# EasyEDA Pro project 智能车.eprj, board PCB6
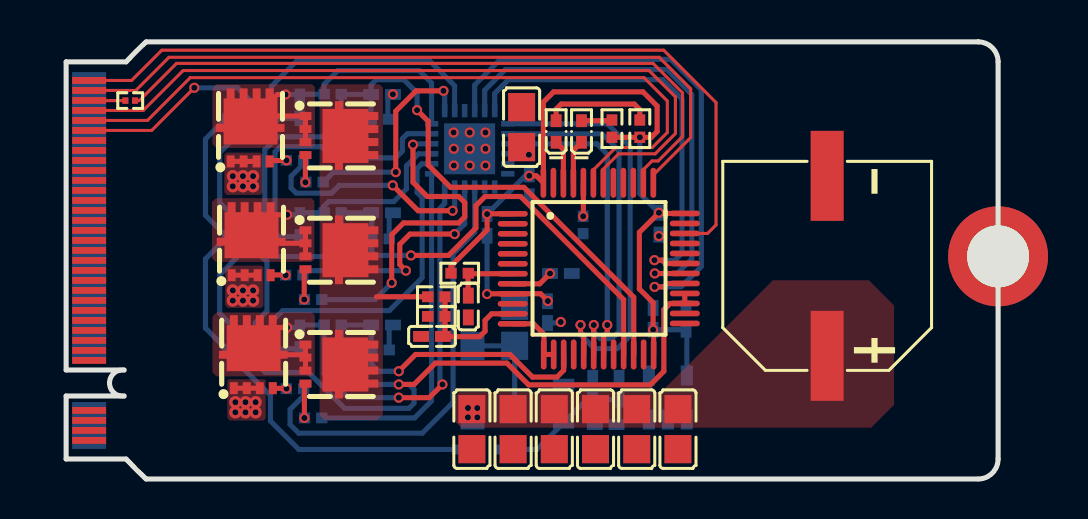
[diagram p18: board, top side]
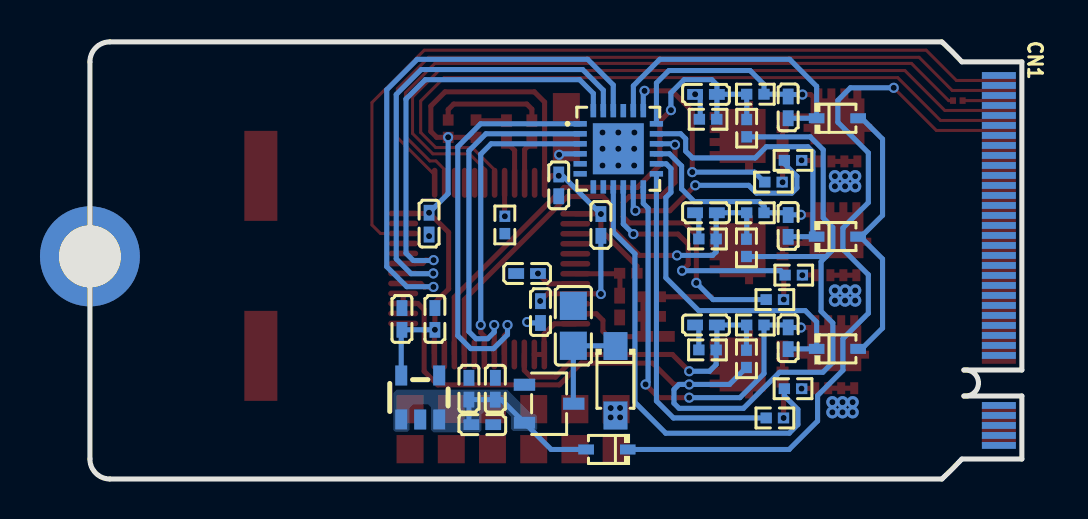
[diagram p19: board, bottom side, seen from below]

Outline 47.95 x 21.95 mm; copper layers: Top Layer, Bottom Layer. Coordinates in mm from the lower left corner of the outline.
Outline path: 5.31,0 46.95,0 arc(47.66,0.29) 47.95,1 47.95,20.86 arc(47.66,21.57) 46.95,21.86 5.33,21.86
Stack: Top Layer 0.035mm / Dielectric1 1.51mm FR4 er 4.5 / Bottom Layer 0.035mm

## Design rules (mm)
template: 自定义配置
spacing copperThickness1oz (default): track to track 0.102, other pairs 0.152 to 0.3
spacing copperThickness2oz: track to track 0.203, other pairs 0.152 to 0.3
track width copperThickness1oz (default): min 0.127, default 0.254, max 2.54
track width copperThickness2oz: min 0.203, default 0.254, max 2.54
differential pair differentialPair (default): width min 0.127, default 0.254, max 2.54; gap min 0.152, default 0.152
via viaSize (default): diameter min 0.5, default 0.61, max 10; hole min 0.3, default 0.305, max 6.299

## Placement (name value [footprint] x y rotation side)
C1  100nF  [C0402]  25.4 8.35 90 bottom
C2  22uF  [C0805]  21.62 2.49 90 top
C3  22uF  [C0805]  23.68 2.49 90 top
C4  22uF  [C0805]  25.74 2.49 90 top
C5  22uF  [C0805]  27.8 2.49 90 top
C6  22uF  [C0805]  29.87 2.49 90 top
C7  22uF  [C0805]  31.93 2.49 90 top
C8  470uF  [CAP-SMD_BD10.0-L10.3-W10.3-LS11.3-FD]  39.4 10.66 90 top
C9  4.7uF  [C0402]  13.01 18.58 270 bottom
C10  4.7uF  [C0402]  13.01 12.65 270 bottom
C11  4.7uF  [C0402]  13.01 7.04 270 bottom
C12  22uF  [C0805]  24.1 17.59 270 top
C25  100nF  [C0402]  17.12 19.23 180 bottom
C26  100nF  [C0402]  17.12 13.31 180 bottom
C27  100nF  [C0402]  17.12 7.7 180 bottom
C28  100nF  [C0402]  30.98 12.77 90 bottom
C29  100nF  [C0402]  24.49 14.68 90 bottom
C30  100nF  [C0402]  30.69 8 270 bottom
C31  100nF  [C0402]  21.44 8.62 90 top
C32  100nF  [C0402]  19.62 7.13 0 top
C33  10uF  [C0402]  32.33 8 270 bottom
C34  10uF  [C0402]  28.31 2.72 0 bottom
C35  22nF  [C0805]  23.76 7.66 270 bottom
C36  10uF  [C0402]  27.66 4.52 270 bottom
C37  100nF  [C0402]  28.98 4.52 270 bottom
CN1  91302-42-067RDM  [M.2_M-KEY]  2.46 10.93 270 bottom
D1  B5819WS  [SOD-323_L1.7-W1.3-LS2.5-FD]  10.54 18.04 0 bottom
D2  B5819WS  [SOD-323_L1.7-W1.3-LS2.5-FD]  10.54 12.12 0 bottom
D3  B5819WS  [SOD-323_L1.7-W1.3-LS2.5-FD]  10.54 6.51 0 bottom
D5  DSK34  [SOD-123FL_L2.7-W1.8-LS3.8-RD]  21.65 4.91 270 bottom
D7  B5819WS  [SOD-323_L1.7-W1.3-LS2.5-FD]  22.07 1.48 180 bottom
L1  CBG100505U000T  [L0402]  22.38 12.7 90 bottom
L2  CBG100505U000T  [L0402]  26.07 10.28 0 bottom
LED1  -  [LED_0402]  27.1 17.38 90 top
LED2  -  [LED_0402]  25.83 17.38 90 top
NOREF  -  [Pad_e695]  47.95 11.13 0 top
R1  10K  [R0402]  27.18 12.7 90 bottom
R2  4.7R  [R0402]  13.67 8.97 180 bottom
R3  4.7R  [R0402]  13.67 3.05 180 bottom
R4  4.7R  [R0402]  12.76 15.94 180 bottom
R5  4.7R  [R0402]  12.73 10.2 180 bottom
R6  4.7R  [R0402]  12.76 4.52 180 bottom
R8  4.7R  [R0402]  13.74 14.85 180 bottom
R19  10K  [R0402]  14.65 19.24 180 bottom
R20  10K  [R0402]  14.65 13.31 180 bottom
R21  10K  [R0402]  14.65 7.7 180 bottom
R22  1K  [R0402]  15.08 17.54 270 bottom
R23  1K  [R0402]  15.09 11.56 270 bottom
R24  1K  [R0402]  15.09 6.01 270 bottom
R25  1K  [R0402]  17.01 17.99 180 bottom
R26  1K  [R0402]  17.04 12 180 bottom
R27  1K  [R0402]  17.04 6.46 180 bottom
R28  10K  [R0402]  21.01 10.29 180 top
R29  1K  [R0402]  28.63 17.52 90 top
R30  2.7K  [R0402]  30.02 17.52 90 top
R31  47K  [R0402]  19.84 9.11 180 top
R32  10K  [R0402]  19.84 8.13 0 top
R34  100  [R0201]  4.52 18.92 180 top
U1  -  [LQFP-48_48P-L7.0-W7.0-P0.50-LS9.7-BL]  27.97 10.52 270 top
U3  TPN2R703NL  [TSON-8_L3.1-W3.1-P0.65-LS3.3-BL-EP]  14.96 17.17 270 top
U4  TPN2R703NL  [TSON-8_L3.1-W3.1-P0.65-LS3.3-BL-EP]  10.52 17.56 0 top
U5  TPN2R703NL  [TSON-8_L3.1-W3.1-P0.65-LS3.3-BL-EP]  14.96 11.46 270 top
U6  TPN2R703NL  [TSON-8_L3.1-W3.1-P0.65-LS3.3-BL-EP]  14.96 5.75 270 top
U7  TPN2R703NL  [TSON-8_L3.1-W3.1-P0.65-LS3.3-BL-EP]  10.57 11.87 0 top
U8  TPN2R703NL  [TSON-8_L3.1-W3.1-P0.65-LS3.3-BL-EP]  10.68 6.22 0 top
U10  FD6288Q  [QFN-24_L4.0-W4.0-P0.50-BL-EP2.6]  21.51 16.51 270 bottom
U11  RT9013-33GB-MS  [SOT-23-5_L2.9-W1.6-P0.95-LS2.8-BR]  31.42 4.08 270 bottom
U12  SE8650X2-HF  [SOT-23-3_L2.9-W1.6-P1.90-LS2.8-BR]  24.97 3.76 0 bottom

## Footprints (pads in the part's own frame, mm; a bottom-side part is the same pattern mirrored in y, then rotated)
C0402
  rect 0.79x0.54 smd: 1(-0.545,0) 2(0.545,0)
C0805
  rect 1.41x1.35 smd: 1(-1,0) 2(1,0)
CAP-SMD_BD10.0-L10.3-W10.3-LS11.3-FD
  rect 4.5x1.65 smd: 1(-4.5,0) 2(4.5,0)
L0402
  rect 0.79x0.54 smd: 1(-0.545,0) 2(0.545,0)
LED_0402
  rect 0.637x0.541 smd: 1(-0.538,0) 2(0.538,0)
LQFP-48_48P-L7.0-W7.0-P0.50-LS9.7-BL
  oval 0.28x1.5 smd: 1(-2.743,-4.306) 2(-2.243,-4.306) 3(-1.742,-4.306) 4(-1.242,-4.306) 5(-0.742,-4.306) 6(-0.241,-4.306) 7(0.257,-4.306) 8(0.757,-4.306) 9(1.258,-4.306) 10(1.758,-4.306) 11(2.258,-4.306) 12(2.759,-4.306) 25(2.743,4.306) 26(2.243,4.306) 27(1.742,4.306) 28(1.242,4.306) 29(0.742,4.306) 30(0.241,4.306) 31(-0.257,4.306) 32(-0.757,4.306) 33(-1.258,4.306) 34(-1.758,4.306) 35(-2.258,4.306) 36(-2.759,4.306)
  oval 1.5x0.28 smd: 13(4.293,-2.756) 14(4.293,-2.256) 15(4.293,-1.755) 16(4.293,-1.255) 17(4.293,-0.754) 18(4.293,-0.254) 19(4.293,0.244) 20(4.293,0.744) 21(4.293,1.244) 22(4.293,1.745) 23(4.293,2.245) 24(4.293,2.745) 37(-4.293,2.731) 38(-4.293,2.23) 39(-4.293,1.73) 40(-4.293,1.23) 41(-4.293,0.729) 42(-4.293,0.229) 43(-4.293,-0.269) 44(-4.293,-0.769) 45(-4.293,-1.27) 46(-4.293,-1.77) 47(-4.293,-2.271) 48(-4.293,-2.771)
M.2_M-KEY
  rect 0.34x1.7 smd: 1(-9.251,0.001) 3(-8.75,0) 5(-8.249,0) 7(-7.75,0) 9(-7.25,0) 11(-6.75,0) 13(-6.25,0) 15(-5.75,0) 17(-5.25,0) 19(-4.75,0) 21(-4.25,0) 23(-3.749,0) 25(-3.249,0) 27(-2.749,0) 29(-2.249,0) 31(-1.75,0) 33(-1.25,0) 35(-0.75,0) 37(-0.249,0) 39(0.251,0) 41(0.75,0) 43(1.25,0) 45(1.75,0) 47(2.251,0) 49(2.751,0) 51(3.251,0) 53(3.751,0) 55(4.25,0) 57(4.75,0) 67(7.25,0) 69(7.75,0) 71(8.251,0) 73(8.751,0) 75(9.251,0)
  rect 0.34x1.7 smd far side: 2(-9.001,0.001) 4(-8.501,0) 6(-8.001,0) 8(-7.501,0) 10(-7.001,0) 12(-6.501,0) 14(-6.001,0) 16(-5.501,0) 18(-5.001,0) 20(-4.499,-0.001) 22(-4.001,0) 24(-3.501,0) 26(-3.001,0) 28(-2.501,0) 30(-2.001,0) 32(-1.501,0) 34(-1.001,0) 36(-0.501,0) 38(-0.001,0) 40(0.499,0) 42(0.998,-0.001) 44(1.499,0) 46(1.999,0) 48(2.499,0) 50(2.999,0) 52(3.499,0) 54(3.999,0) 56(4.499,0) 58(4.999,0) 68(7.499,0) 70(7.999,0) 72(8.499,0) 74(8.999,0)
Pad_e695
  round 5 hole 3.1: 3(0,0)
QFN-24_L4.0-W4.0-P0.50-BL-EP2.6
  rect 0.28x0.665 smd: 1(-1.25,-1.907) 2(-0.75,-1.907) 3(-0.25,-1.907) 4(0.25,-1.907) 5(0.75,-1.907) 6(1.25,-1.907) 13(1.25,1.907) 14(0.75,1.907) 15(0.25,1.907) 16(-0.25,1.907) 17(-0.75,1.907) 18(-1.25,1.907)
  rect 0.665x0.28 smd: 7(1.907,-1.25) 8(1.907,-0.75) 9(1.907,-0.25) 10(1.907,0.25) 11(1.907,0.75) 12(1.907,1.25) 19(-1.907,1.25) 20(-1.907,0.75) 21(-1.907,0.25) 22(-1.907,-0.25) 23(-1.907,-0.75) 24(-1.907,-1.25)
  rect 2.55x2.55 smd: 25(0,0)
R0201
  rect 0.303x0.324 smd: 1(-0.241,0) 2(0.241,0)
R0402
  rect 0.566x0.54 smd: 1(-0.433,0) 2(0.433,0)
SOD-123FL_L2.7-W1.8-LS3.8-RD
  rect 1.4x1.2 smd: 1(-1.735,0) 2(1.735,0)
SOD-323_L1.7-W1.3-LS2.5-FD
  rect 0.78x0.5 smd: 1(-1.04,0) 2(1.04,0)
SOT-23-3_L2.9-W1.6-P1.90-LS2.8-BR
  rect 1.07x0.6 smd: 1(1.235,-0.95) 2(1.235,0.95) 3(-1.235,0)
SOT-23-5_L2.9-W1.6-P0.95-LS2.8-BR
  rect 1x0.6 smd: 1(1.1,-0.95) 2(1.1,0) 3(1.1,0.95) 4(-1.1,0.95) 5(-1.1,-0.95)
TSON-8_L3.1-W3.1-P0.65-LS3.3-BL-EP
  rect 0.4x0.6 smd: 1(-0.975,-1.675) 2(-0.325,-1.675) 3(0.325,-1.675) 4(0.975,-1.675) 5(0.975,1.675) 6(0.325,1.675) 7(-0.325,1.675) 8(-0.975,1.675)
  rect 0.6x0.4 smd: 9(-1.42,0) 9(1.42,0)
  rect 2.7x2.3 smd: 9(0.02,0.325)

## Nets
As in the schematic.

Pads without a net: CN1 20 40; NOREF 3; U1 2 3 4 5 6 10 16 20 25 26 32 33 39 40 41; U10 5 7 8 21; U11 4

## Via types
v1: diameter 0.508, hole 0.305, Top Layer to Bottom Layer, 56 vias
v2: diameter 0.61, hole 0.305, Top Layer to Bottom Layer, 18 vias

## Routing (per net, layer and track width the routed paths; a pad name or vN(x,y) marks a point on that pad's centre or on a via; arc(x,y) is an arc through that point)
3V3: length 39.9
  Top Layer w0.254: R29.1 R30.1 30.59,17.09 30.89,17.38 30.89,18.65 30.18,19.36 25.71,19.36 25.19,18.85 U1.48 24.84,15.16 v1(24.49,15.16) ; U1.24 30.71,7.44 v1(30.68,7.46) 30.68,8.82 30,9.5 30,12.33 v1(30.98,13.31) 31.01,13.28 U1.36 ; R28.2 20.57,10.65 22.38,12.45 v1(22.38,13.25) 22.39,13.26 U1.1
  Bottom Layer w0.254: v1(22.38,13.25) 24.36,15.23 24.49,15.23 ; 32.37,5.18 32.37,7.46 v1(30.68,7.46) ; v1(30.02,17.09) 30.02,14.27 v1(30.98,13.31)
5V: length 8.2
  Bottom Layer w0.254: C34.2 28.98,2.84 C37.2 C36.2 27.36,3.97 26.2,2.81 24.87,1.48 D7.1
GND: length 8.6
  Top Layer w0.254: U8.3 U8.2 U8.1 ; U7.1 U7.2 U7.3 ; U4.1 U4.2 U4.3
  Bottom Layer w0.254: v1(26.06,7.85) 26.02,7.8 C1.1 ; C27.1 17.48,7.51 R27.1 ; C26.1 17.48,13.13 R26.1 ; 17.41,17.98 17.41,19.3 17.41,19.31
  vias: v1(17.66,19.24) v1(20.7,17.33) v1(20.71,16.51) v1(20.71,15.68) v1(21.51,17.33) v1(21.51,16.51) v1(21.51,15.68) v1(22.3,17.33) v1(22.3,16.51) v1(22.3,15.68) v1(30.98,12.15) v2(9.65,15.14) v2(9.65,14.64) v2(9.65,9.43) v2(9.65,8.92) v2(9.78,3.84) v2(9.78,3.33) v2(10.16,15.14) v2(10.16,14.64) v2(10.16,9.43) v2(10.16,8.92) v2(10.29,3.84) v2(10.29,3.33) v2(10.67,15.14) v2(10.67,14.64) v2(10.67,9.43) v2(10.67,8.92) v2(10.79,3.84) v2(10.79,3.33)
VCCBAT: length 17.5
  Top Layer w0.254: R31.2 16.84,9.11
  Bottom Layer w0.254: D2.1 9.4,12.12 ; 9.4,12.12 8.28,11 8.28,7.55 9.32,6.51 D3.1 ; 9.4,12.12 9.34,12.12 8.28,13.19 8.28,17 9.32,18.04 D1.1 ; U10.4 24.42,16.26 v1(24.47,16.21)
  vias: v1(21.42,3.55) v1(21.42,3.08) v1(21.89,3.55) v1(21.89,3.08)
ABMF1: length 26.9
  Top Layer w0.254: v1(18.87,18.44) 19.43,17.89 19.43,15.7 20.55,14.58 24.22,14.58 29.72,9.09 29.72,6.22
  Bottom Layer w0.254: v1(18.87,18.44) 18.87,19.31 18.21,19.97 16.83,19.97 16.57,19.71 16.57,19.23 ; 16.57,19.23 16.57,17.98 ; 16.57,19.23 16.57,19.24 15.09,19.24 15.08,19.25 15.08,17.98
BATADC: length 6.3
  Top Layer w0.254: U1.11 22.6,8.26 22.28,7.93 22.28,7.39 22,7.12 20.18,7.12 C32.2 20.27,7.24 R32.2 R31.1
BBMF1: length 24.2
  Top Layer w0.254: U1.21 29.21,8.97 24.05,14.13 22.28,14.13 21.82,13.67 21.82,12.55 20.45,11.18 v1(18.57,11.18)
  Bottom Layer w0.254: R23.1 15.08,12 R20.1 C26.2 16.61,13.28 R26.2 16.61,11.36 16.79,11.18 v1(18.57,11.18)
CBMF1: length 16.2
  Top Layer w0.254: U1.15 26.21,5.44 25.87,5.1 24.65,5.1 23.52,6.23 18.8,6.23 v1(17.96,5.39)
  Bottom Layer w0.254: v1(17.96,5.39) 16.94,5.39 16.61,5.72 R27.2 16.57,6.49 C27.2 R21.1 15.09,7.69 R24.1
CLK: length 36.9
  Top Layer w0.152: CN1.4 4.8,19.43 6.45,21.09 30.99,21.09 32.56,19.51 32.56,17.07 30.7,15.21 U1.37
DIO: length 40.9
  Top Layer w0.152: U1.34 33.41,12.28 33.83,12.7 33.83,18.83 31.22,21.44 6.1,21.44 4.58,19.93 CN1.2
ERR: length 2.2
  Top Layer w0.254: LED1.1 26.7,16.43 U1.45
HOA1: length 10.8
  Top Layer w0.254: v1(17.81,15.35) 17.81,18.39 18.82,19.41 v1(20.19,19.41)
  Bottom Layer w0.254: 14.1,14.76 14.69,15.35 v1(17.81,15.35) ; v1(20.19,19.41) 20.26,19.35 U10.19
HOB1: length 16.8
  Top Layer w0.254: v1(18.67,16.72) 18.67,14.84 19.38,14.13 20.95,14.13 21.26,13.82 21.26,13.11 20.95,12.81 18.2,12.81 17.6,12.21 v1(17.6,9.81)
  Bottom Layer w0.254: v1(18.67,16.72) 18.71,16.76 U10.16 ; R2.1 16.76,8.97 v1(17.6,9.81)
HOC1: length 17.2
  Bottom Layer w0.254: U10.13 19.6,3.9 18.75,3.05 R3.1
LOA1: length 11.8
  Top Layer w0.254: v1(17.65,14.69) 18.92,13.42 v1(20.65,13.42)
  Bottom Layer w0.254: v1(17.65,14.69) 14.98,14.69 14.59,14.3 12.82,14.3 12.57,14.55 12.57,15.14 13.21,15.78 13.21,15.95 ; U10.11 20.76,13.52 v1(20.65,13.42)
LOB1: length 12.2
  Top Layer w0.254: v1(20.75,12.25) 18.52,12.25 18.01,11.74 18.01,10.72 v1(18.31,10.42)
  Bottom Layer w0.254: U10.10 21.26,12.75 v1(20.75,12.25) ; R5.1 13.38,10.42 v1(18.31,10.42)
LOC1: length 22.3
  Bottom Layer w0.254: U10.9 21.76,12.34 20.67,11.26 20.67,3.83 19.13,2.29 12.95,2.29 12.52,2.72 12.52,3.48 13.19,4.16 R6.1
MID1: length 52.4
  Top Layer w0.254: v1(17.96,4.73) 18.72,4.73 19.78,5.79 23.37,5.79 24.45,4.71 30.54,4.71 31.22,5.39 31.22,8.47 31.53,8.78 U1.27 32.27,9.28
  Bottom Layer w0.254: 11.1,11.13 15.09,11.13 ; 11.1,11.13 10.77,11.46 10.77,12.58 11.25,13.06 11.25,16.46 11.9,17.11 15.08,17.11 ; 11.1,11.13 11.36,10.87 11.36,8.39 10.77,7.8 10.77,5.83 11.27,5.34 13.44,5.34 15.24,3.53 18.47,3.53 18.72,3.79 18.72,4.47 18.47,4.73 v1(17.96,4.73) 15.94,4.73 R24.2
NRST: length 3.6
  Top Layer w0.254: 21.42,8.92 21.42,10.27 R28.1 21.46,10.26 U1.7
PWMAH1: length 26.9
  Top Layer w0.254: v1(30.76,9.61) 31.22,9.61 31.39,9.78 U1.29
  Bottom Layer w0.254: 21.76,18.45 21.76,19.71 23.04,20.98 31.57,20.98 33.1,19.46 33.1,10.62 32.09,9.62 30.77,9.62 v1(30.76,9.61)
PWMAL1: length 21.1
  Top Layer w0.254: U1.17 27.21,7.16 27.05,7.32 v1(27.05,7.7)
  Bottom Layer w0.254: v1(27.05,7.7) 27.05,7.22 27.75,6.52 28.89,6.52 29.54,7.17 29.54,16.62 28.39,17.76 U10.1
PWMBH1: length 24.2
  Top Layer w0.254: v1(30.77,10.28) 30.77,10.28 U1.30
  Bottom Layer w0.254: v1(30.77,10.28) 30.78,10.27 31.88,10.27 32.62,11.01 32.62,19.23 31.37,20.48 23.29,20.48 22.26,19.44 U10.23
PWMBL1: length 18.3
  Top Layer w0.254: v1(27.72,7.7) 27.71,7.7 U1.18
  Bottom Layer w0.254: U10.2 28.13,17.26 28.98,16.41 28.98,7.37 28.63,7.02 28.04,7.02 27.72,7.34 v1(27.72,7.7)
PWMCH1: length 21.8
  Top Layer w0.254: U1.31 31.3,10.78 31.13,10.94 v1(30.75,10.94)
  Bottom Layer w0.254: U10.24 22.76,19.28 23.44,19.97 31.17,19.97 32.13,19 32.13,11.29 31.76,10.93 30.77,10.93 v1(30.75,10.94)
PWMCL1: length 15.3
  Top Layer w0.254: v1(28.39,7.7) 28.39,7.32 28.21,7.14 U1.19
  Bottom Layer w0.254: v1(28.39,7.7) 28.39,16.24 27.87,16.76 U10.3
PWMIN: length 34.3
  Top Layer w0.152: U1.38 30.2,15.47 30.63,15.91 30.94,15.91 32.16,17.12 32.16,19.31 30.68,20.78 6.83,20.78 4.97,18.92 R34.1
RUN: length 2.2
  Top Layer w0.254: U1.46 26.19,16.48 LED2.1
RX: length 37
  Top Layer w0.152: CN1.10 5.38,17.93 7.52,20.07 30.23,20.07 31.4,18.9 31.4,17.33 30.64,16.57 28.81,16.57 27.7,15.46 U1.43
TX: length 37.6
  Top Layer w0.152: U1.42 28.19,15.5 28.96,16.26 30.79,16.26 31.8,17.28 31.8,19.11 30.48,20.43 7.16,20.43 5.17,18.43 CN1.8
VSA1: length 16.6
  Top Layer w0.254: 10.81,18.15 U4.9 ; 10.81,18.15 11.88,19.23 v1(12.29,19.23) ; 10.81,18.15 13.29,18.15 U3.3
  Bottom Layer w0.254: U10.18 19.6,19.8 18.97,20.43 14.91,20.43 14.22,19.73 R19.2 13.12,19.24 C9.1 12.91,19.23 v1(12.29,19.23)
VSB1: length 14.4
  Top Layer w0.254: v1(12.37,13.21) 11.61,13.21 U7.9 ; U7.9 12.07,11.79 U5.2 ; U5.2 U5.3 ; U5.2 U5.1
  Bottom Layer w0.254: 13.12,13.31 13.04,13.31 ; 13.12,13.31 C10.1 12.99,13.21 v1(12.37,13.21) ; 13.12,13.31 14.14,13.31 14.2,13.25 ; R20.2 14.2,13.3 14.2,13.62 14.46,13.87 17.71,13.87 18.34,14.51 18.34,15.65 18.95,16.26 19.7,16.26 19.7,16.27
VSC1: length 25.7
  Top Layer w0.254: U8.9 13.14,6.22 U6.2 ; v1(20.14,4.73) 19.48,4.07 v1(17.96,4.07) ; U6.2 U6.1 ; U6.2 U6.3 ; v1(12.37,7.57) 11.73,7.57 U8.9
  Bottom Layer w0.254: v1(12.37,7.57) 13,7.57 C11.1 13.12,7.7 R21.2 14.22,5.27 15.42,4.07 v1(17.96,4.07) ; v1(20.14,4.73) 20.02,4.86 20.02,13.54 20.26,13.78 U10.12
$1N1069: length 1.7
  Top Layer w0.254: U1.44 27.2,13.15 v1(27.18,13.14)
$1N1347: length 6.2
  Top Layer w0.254: 23.6,9.27 23.61,9.26 25.05,9.26 v1(25.42,8.9) ; v1(22.38,9.25) 22.39,9.26 U1.9
  Bottom Layer w0.254: v1(22.38,9.25) L1.1
$1N1396: length 2.1
  Top Layer w0.254: v1(25.53,10.28) 25.01,9.76 23.66,9.76
$1N1527: length 3.3
  Top Layer w0.254: U1.12 24.7,7.76 25.22,7.24 25.22,6.24 U1.13 U1.14
$1N2236: length 1.5
  Top Layer w0.254: LED1.2 28.59,17.92 R29.2
$1N2286: length 5.5
  Top Layer w0.254: R30.2 30.02,18.47 29.74,18.75 26.09,18.75 25.83,18.5 LED2.2
$1N6623: length 1.8
  Top Layer w0.152: R34.2 2.47,18.92 CN1.6
$1N6887: length 38.1
  Top Layer w0.152: CN1.12 5.59,17.43 v1(7.72,19.56)
  Bottom Layer w0.254: D7.2 12.96,1.48 11.53,2.9 11.53,4.17 10.26,5.44 10.26,7.02 8.99,8.29 8.99,10.22 10.26,11.49 10.26,12.55 8.99,13.82 8.99,16.31 10.52,17.84 10.52,18.94 9.89,19.56 v1(7.72,19.56)
$2N1275: length 1.4
  Top Layer w0.254: v1(13.28,14.84) 13.28,16.18 13.31,16.21
$2N1276: length 1.7
  Top Layer w0.254: v1(13.23,3.05) 13.23,4.79 13.24,4.79
$2N1277: length 1.5
  Top Layer w0.254: 13.22,10.47 13.23,10.47 v1(13.23,8.97)
$2N1296: length 0.7
  Top Layer w0.254: v1(12.3,10.19) 12.28,10.2 11.56,10.2
$2N1297: length 0.7
  Top Layer w0.254: 11.66,4.53 12.32,4.53 v1(12.34,4.52)
$2N1333: length 14.8
  Bottom Layer w0.254: D2.2 11.77,12.31 11.77,16.36 12.02,16.62 14.1,16.62 14.66,16.06 17.8,16.06 18.14,16.39 18.14,17.01 18.39,17.27 19.6,17.27 ; 11.58,12.12 13.02,12.12 13.03,12.1
$2N1334: length 17.6
  Bottom Layer w0.254: C11.2 12.99,6.51 D3.2 11.58,7.85 12.15,8.42 17.49,8.42 19.13,10.06 19.13,14.08 18.87,14.33 18.87,15.52 19.11,15.76 U10.14
$2N1335: length 14.5
  Bottom Layer w0.254: 13,18.04 D1.2 11.58,19.64 12.93,20.98 19.43,20.98 20.75,19.66 20.75,18.42 U10.20
$2N1336: length 0.9
  Top Layer w0.254: v1(12.34,15.93) 12.33,15.93 11.47,15.93
$2N2310: length 5
  Bottom Layer w0.254: D5.1 21.66,6.66 C35.2 23.76,3.79 U12.3

## Copper pours and planes (outline as drawn; the poured copper is in the pictures)
5V on Bottom Layer: 25.57,4.46 32.76,4.46 32.76,2.33 25.57,2.33
GND on Top Layer: 9.38,4.99 11.29,4.99 11.29,2.92 9.38,2.92
GND on Top Layer: 9.27,10.67 11.18,10.67 11.18,8.56 9.27,8.56
GND on Top Layer: 9.22,16.32 11.14,16.32 11.14,14.21 9.22,14.21
VCCBAT on Top Layer: 20.8,9.94 42.75,9.94 42.75,2.56 20.8,2.56
VCCBAT on Top Layer: 13.99,19.74 17.16,19.74 17.16,2.94 13.99,2.94
VSA1 on Top Layer: 8.63,19.74 13.76,19.74 13.76,16.55 8.63,16.55
VSB1 on Top Layer: 8.61,14.04 13.73,14.04 13.73,10.85 8.61,10.85
VSC1 on Top Layer: 8.63,8.33 13.75,8.33 13.75,5.14 8.63,5.14
